# EasyEDA Pro project hardware.eprj, schematic 264主板
Create Date: 2022-11-13; Page Name: P1; Project Name: hardware; Schematic Name: 264主板; Update Date: 2022-12-20; Company: 嘉立创EDA; Page Size: D; Version: V1.0
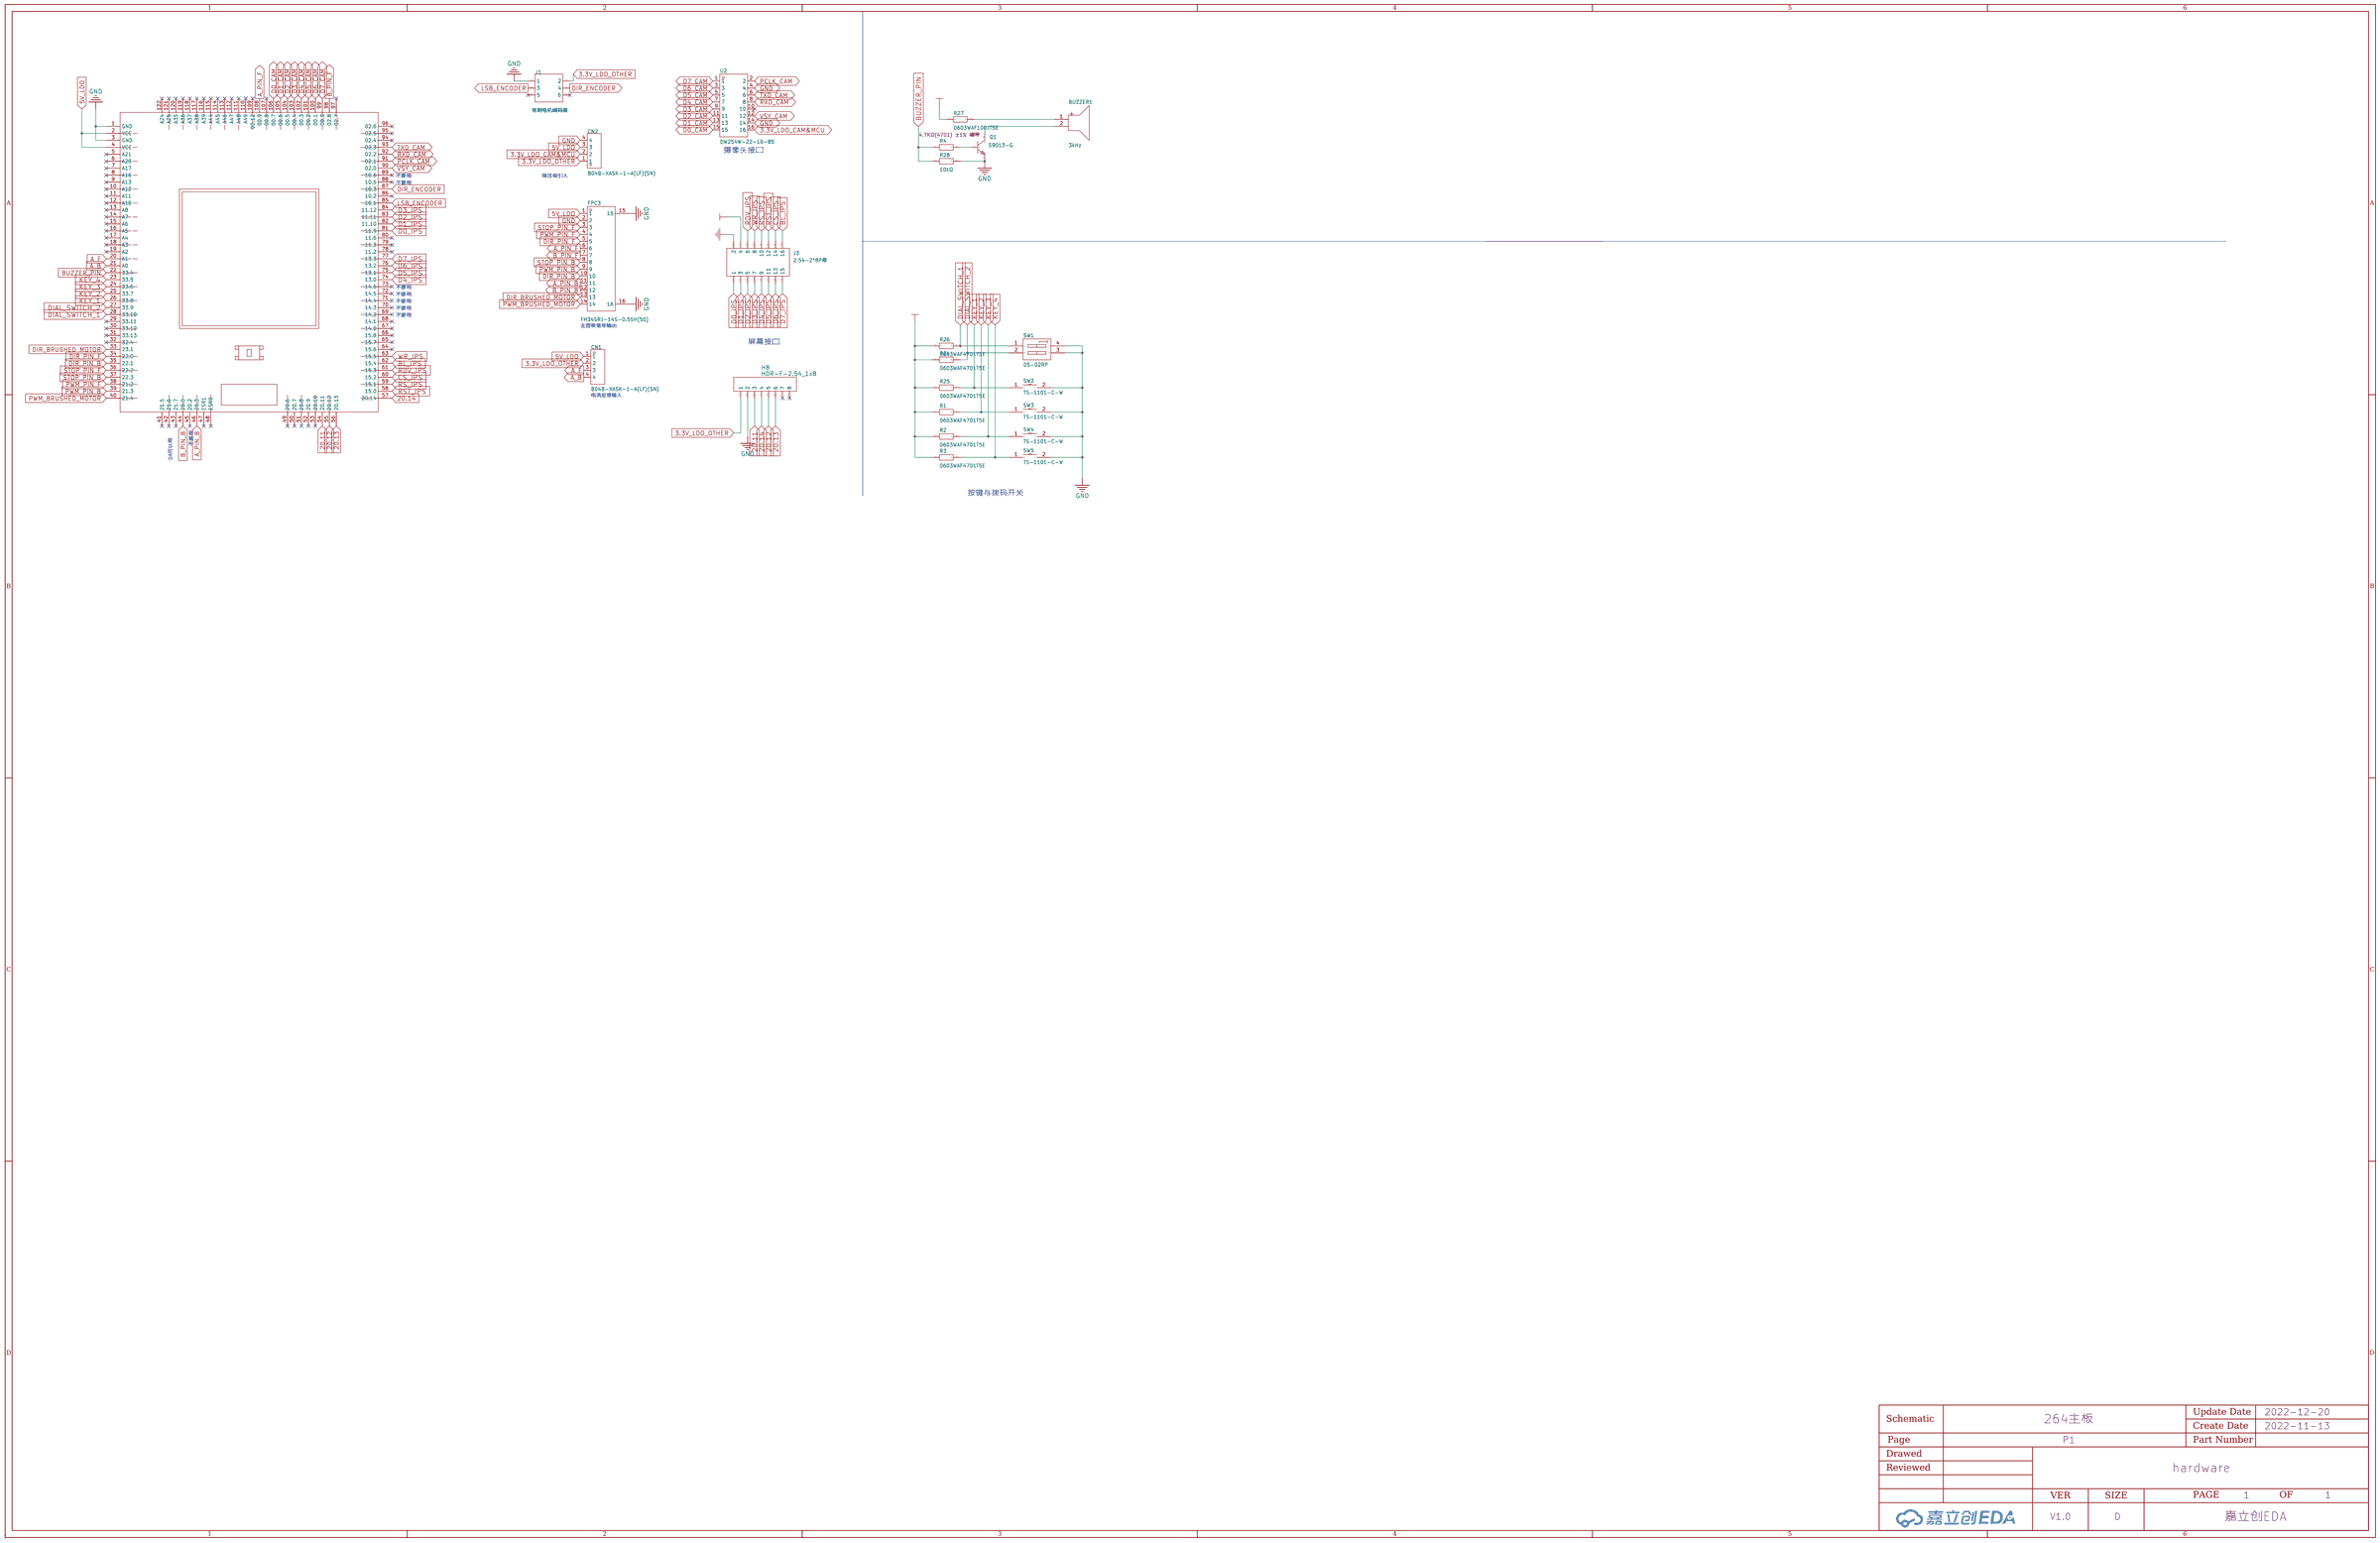
[diagram p0: schematic sheet]

## Parts
BUZZER1  3kHz  [BUZ-TH_BD9.0-P5.00-D0.6-FD]
CN1  B04B-XASK-1-A(LF)(SN)  [CONN-TH_B04B-XASK-1-A-LF-SN]
CN2  B04B-XASK-1-A(LF)(SN)  [CONN-TH_B04B-XASK-1-A-LF-SN]
FPC3  FH34SRJ-14S-0.5SH(50)  [FFC-SMD_14P-P0.50_FH34SRJ-14S-0.5SH]
H8  HDR-F-2.54_1x8  [HDR-F-2.54_1X8]
J1  有刷电机编码器  [HDR-TH_6P-P2.54-V-M-R2-C3-S2.54-1]
J3  2.54-2*8P母  [HDR-TH_16P-P2.54-V-F-R2-C8-S2.54-1]
Q1  S9013-G  [SOT-23-3_L2.9-W1.3-P1.90-LS2.4-BR]
R1  0603WAF4701T5E  [R0603]
R2  0603WAF4701T5E  [R0603]
R3  0603WAF4701T5E  [R0603]
R4  0603WAF4701T5E  [R0603]
R24  0603WAF4701T5E  [R0603]
R25  0603WAF4701T5E  [R0603]
R26  0603WAF4701T5E  [R0603]
R27  0603WAF100JT5E  [R0603]
R28  10kΩ  [R0603]
SW1  DS-02RP  [SW-TH_DS-02XP]
SW2  TS-1101-C-W  [SW-SMD_L6.0-W3.3-LS8.0]
SW3  TS-1101-C-W  [SW-SMD_L6.0-W3.3-LS8.0]
SW4  TS-1101-C-W  [SW-SMD_L6.0-W3.3-LS8.0]
SW5  TS-1101-C-W  [SW-SMD_L6.0-W3.3-LS8.0]
U1  TC387核心板 COPY  [TC264逐飞]
U2  DW254W-22-16-85  [HDR-TH_16P-P2.54-H-F-R2-C8-S2.54-W12.7-N]

## Library data of the parts
BUZZER1 = HNB09A03: 驱动方式:电磁式;构造类型:有源;额定电压:3V;工作电压:1.5V~4.5V;消耗电流:30mA;频率:3kHz;声压(SPL):85dB@10cm;直径(φD):9mm;长度:-;宽度:-;高度:5.5mm;工作温度:-20~+70;; LCSC Part Name: 电磁式有源一体蜂鸣器HNB09A03; Supplier Part: C96102; Manufacturer: 华能; Supplier Footprint: 插件,P=5mm; JLCPCB Part Class: Extended Part; Datasheet: https://atta.szlcsc.com/upload/public/pdf/source/20170522/1495448326172.pdf; Supplier: LCSC; Oscillator Circuit: 电磁式; Technology Type: 有源; Rated Voltage: 3V; Operating Voltage: 1.5V~4.5V; Current Consumption: 30mA; Sound Pressure Level (SPL): 85dB@10cm; Diameter (φD): 9mm; Height: 5.5mm; Operating Temperature: -20~+70
CN1 CN2 = B04B-XASK-1-A(LF)(SN): 参考系列:XA;间距:2.5mm;插针结构:1x4P;排数:1;每排PIN数:4;行距:-;公母:公型插针;安装方式:直插;额定电流:3A;工作温度范围:-25~+85;; LCSC Part Name: 4P 脚距2.5mm; Supplier Part: C491709; Manufacturer: JST; Supplier Footprint: 插件,P=2.5mm; JLCPCB Part Class: Extended Part; Datasheet: https://atta.szlcsc.com/upload/public/pdf/source/20200416/C514162_2DCD7D1CD2019D14145B8FEA1B6236C2.pdf; Supplier: LCSC; Reference Series: XA; Pitch: 2.5mm; Pins Structure: 1x4P; Number of Rows: 1; Number of PINs Per Row: 4; Gender: 公型插针; Mounting Style: 直插; Current Rating (Max): 3A; Operating Temperature Range: -25~+85
FPC3 = FH34SRJ-14S-0.5SH(50): 间距:0.5mm;触点数量:14;锁定特性:-;安装类型:卧贴;触点类型:双侧触点/上下接;; LCSC Part Name: 0.5mm P数:14 双侧触点/上下接; Supplier Part: C324724; Manufacturer: HRS(广濑); Supplier Footprint: SMD,P=0.5mm; JLCPCB Part Class: Extended Part; Datasheet: https://atta.szlcsc.com/upload/public/pdf/source/20181106/C324724_DC7CE3D3468642B05BE9C7F247386E31.pdf; Supplier: LCSC; Pitch: 0.5mm; Number of Contacts: 14; Mounting Type: 卧贴; Contact Type: 双侧触点/上下接; Height Above Board: 1mm; FFC, FCB Thickness: 0.3mm
H8 = HDR-F-2.54_1x8: Supplier Part: C225505; Supplier: LCSC
J1 = 2.54-2*3P针: 间距:2.54mm;总PIN位数:6;排数:2;插针结构:-;行距:-;安装类型:直插;圆针/方针:-;额定电流:-;额定电压:-;配合针长度:-;塑高:-;触头材质:-;触头镀层:-;颜色:黑色;; LCSC Part Name: 2.54mm 直插; Supplier Part: C65114; Manufacturer: BOOMELE(博穆精密); Supplier Footprint: 直插,P=2.54mm; JLCPCB Part Class: Extended Part; Datasheet: https://atta.szlcsc.comnull; Supplier: LCSC; Pitch: 2.54mm; Number of Pins: 6; Number of Rows: 2; Mounting Type: 直插; Color: 黑色
J3 = 2.54-2*8P母: 间距:2.54mm;总孔位数:16;排数:2;插孔结构:2x8P;行距:2.54mm;安装类型:直插;塑高:-;触头材质:黄铜;触头镀层:-;; LCSC Part Name: 2.54mm 2x8P; Supplier Part: C30734; Manufacturer: BOOMELE(博穆精密); Supplier Footprint: 直插,P=2.54mm; JLCPCB Part Class: Extended Part; Datasheet: https://atta.szlcsc.com/upload/public/pdf/source/20151109/1457707555924.pdf; Supplier: LCSC; Pitch: 2.54mm; Number of Holes: 16; Number of Rows: 2; Holes Structure: 2x8P; Row Spacing: 2.54mm; Mounting Type: 直插; Contact Material: 黄铜
Q1 = S9013-G: 晶体管类型:NPN;集射极击穿电压(Vceo):25V;集电极电流(Ic):500mA;功率(Pd):300mW;; LCSC Part Name: S9013 H档(200-350) H档(200-350); Supplier Part: C164888; Manufacturer: CJ(江苏长电/长晶); Supplier Footprint: SOT-23(SOT-23-3); JLCPCB Part Class: Extended Part; Datasheet: https://atta.szlcsc.com/upload/public/pdf/source/20171228/C164888_15144412896081213891.pdf; Supplier: LCSC; Transistor Type: NPN; Collector-Emitter Breakdown Voltage (Vceo): 25V; Collector Current (Ic): 500mA; Power Dissipation (Pd): 300mW
R1-R4 R24-R26 = 0603WAF4701T5E: LCSC Part Name: 4.7KΩ(4701) ±1% 编带; Supplier Part: C23162; Manufacturer: UNI-ROYAL(厚声); Supplier Footprint: 0603; JLCPCB Part Class: Basic Part; Datasheet: https://atta.szlcsc.com/upload/public/pdf/source/20170920/C23162_1505901109673982545.pdf; Supplier: LCSC
R27 = 0603WAF100JT5E: LCSC Part Name: 10Ω(10R0) ±1% 编带; Supplier Part: C22859; Manufacturer: UNI-ROYAL(厚声); Supplier Footprint: 0603; JLCPCB Part Class: Basic Part; Datasheet: https://atta.szlcsc.com/upload/public/pdf/source/20170920/C22859_1505900954295982249.pdf; Supplier: LCSC
R28 = 0603WAF1002T5E: 电阻类型:厚膜电阻;阻值:10kΩ;精度:±1%;功率:100mW;温度系数:±100ppm/;最大工作电压:75V;工作温度范围:-55~+155;; LCSC Part Name: 10kΩ ±1% 100mW; Supplier Part: C25804; Manufacturer: UNI-ROYAL(厚声); Supplier Footprint: 0603; JLCPCB Part Class: Basic Part; Datasheet: https://atta.szlcsc.com/upload/public/pdf/source/20200306/C422600_1E6D84923E4A46A82E41ADD87F860B5C.pdf; Supplier: LCSC; Type: 厚膜电阻; Tolerance: ±1%; Power(Watts): 100mW; Temperature Coefficient: ±100ppm/; Overload Voltage (Max): 75V; Operating Temperature Range: -55~+155
SW1 = DS-02RP: 类型:平拨，凸起式;额定电流:25mA;额定电压:24V;电路结构:单刀单掷;开关位数:2;引脚间距:2.54mm;工作温度:-20~+70;使用寿命:3000;颜色:红色;; LCSC Part Name: 红色2PIN-2.54mm立式直插正拨拨码开关; Supplier Part: C92646; Manufacturer: 韩国韩荣; Supplier Footprint: 插件; JLCPCB Part Class: Extended Part; Datasheet: https://atta.szlcsc.com/upload/public/pdf/source/20210810/ECF2F28B1CE673E7F9581E27682BDB10.pdf; Supplier: LCSC; Type: 平拨，凸起式; Current Rating: 25mA; Voltage Rating: 24V; Circuit: 单刀单掷; Number of Positions: 2; Lead Pitch: 2.54mm; Operating Temperature: -20~+70; Operating Life: 3000; Color: 红色
SW2-SW5 = TS-1101-C-W: 触点电流:50mA;额定电压(DC):12V;绝缘电阻:100mΩ;电路结构:单刀单掷;安装方式:立贴;按钮形状:矩形按钮;按钮/盖帽颜色:白色;带灯:无;作用力:260gf;机械寿命:50000;工作温度:-30~+85;开关长度:6mm;开关宽度:3.6mm;开关高度:2.5mm;带支架:否;; LCSC Part Name: TS-1101-C-W 一型3*6*2.5有白ZD b拉伸白色按键 卷装; Supplier Part: C318938; Manufacturer: XKB Connectivity(中国星坤); Supplier Footprint: SMD; JLCPCB Part Class: Extended Part; Datasheet: https://atta.szlcsc.com/upload/public/pdf/source/20200227/C318938_C2E53B1EEDE37D980A33616AC086DE53.pdf; Supplier: LCSC; Contact Current: 50mA; Voltage Rating (DC): 12V; Insulation Resistance: 100mΩ; Circuit: 单刀单掷; Mounting Style: 立贴; Actuator Style: 矩形按钮; Actuator/Cap Color: 白色; With Lamp: 无; Operating Force: 260gf; Mechanical Life: 50000; Operating Temperature: -30~+85; Switch Length: 6mm; Switch Width: 3.6mm; Switch Height: 2.5mm; Strike Gundam: 否
U1 = TC264核心板 COPY: Supplier: 逐飞
U2 = DW254W-22-16-85: 间距:2.54mm;总孔位数:16;排数:2;插孔结构:2x8P;行距:2.54mm;安装类型:弯插;圆孔/方孔:方孔;额定电流:3A;额定电压:-;插孔方向:侧面;塑高:8.5mm;工作温度范围:-;; LCSC Part Name: 2.54mm 2x8P; Supplier Part: C2936005; Manufacturer: DEALON(德艺隆); Supplier Footprint: 弯插,P=2.54mm; JLCPCB Part Class: Extended Part; Datasheet: https://atta.szlcsc.com/upload/public/pdf/source/20211231/D29517537FCFFABF14C4453E96D14918.pdf; Supplier: LCSC; Pitch: 2.54mm; Number of Holes: 16; Number of Rows: 2; Holes Structure: 2x8P; Row Spacing: 2.54mm; Mounting Type: 弯插; Circular Hole / Square Hole: 方孔; Current Rating (Max): 3A; Holes Direction: 侧面; Insulation Height: 8.5mm

## Nets
3.3V_LDO_CAM&MCU: CN2.2 U2.16
3.3V_LDO_OTHER: CN1.2 CN2.1 H8.1 J1.2 J3.4 R1.1 R2.1 R3.1 R24.1 R25.1 R26.1 R27.1
5V_LDO: CN1.1 CN2.3 FPC3.1 U1.2(VCC) U1.4(VCC)
GND: CN2.4 FPC3.2 FPC3.15 FPC3.16 H8.2 J1.1 J3.2 Q1.2(E) R28.2 SW1.3 SW1.4 SW2.2 SW3.2 SW4.2 SW5.2 U1.1(GND) U1.3(GND) U2.4 U2.14
20.11: H8.3 U1.54(20.11)
20.12: H8.5 U1.55(20.12)
20.13: H8.6 U1.56(20.13)
20.14: H8.4 U1.57(20.14)
A_B: CN1.4 U1.21(A0)
A_F: CN1.3 U1.20(A1)
A_PIN_B: FPC3.11 U1.46(20.3)
A_PIN_F: FPC3.6 U1.108(00.9)
B_PIN_B: FPC3.12 U1.44(20.0)
B_PIN_F: FPC3.7 U1.98(02.8)
BL_IPS: J3.16 U1.62(15.4)
BUZZER_PIN: R4.1 R28.1 U1.22(33.4)
CS_IPS: J3.14 U1.60(15.2)
D0_CAM: U1.106(00.7) U2.15
D0_IPS: J3.1 U1.81(11.9)
D1_CAM: U1.105(00.6) U2.13
D1_IPS: J3.3 U1.82(11.10)
D2_CAM: U1.104(00.5) U2.11
D2_IPS: J3.5 U1.83(11.11)
D3_CAM: U1.103(00.4) U2.9
D3_IPS: J3.7 U1.84(11.12)
D4_CAM: U1.102(00.3) U2.7
D4_IPS: J3.9 U1.74(13.0)
D5_CAM: U1.101(00.2) U2.5
D5_IPS: J3.11 U1.75(13.1)
D6_CAM: U1.100(00.1) U2.3
D6_IPS: J3.13 U1.76(13.2)
D7_CAM: U1.99(00.0) U2.1
D7_IPS: J3.15 U1.77(13.3)
DIAL_SWITCH_1: R26.2 SW1.1(A1) U1.28(33.10)
DIAL_SWITCH_2: R24.2 SW1.2(A2) U1.27(33.9)
DIR_BRUSHED_MOTOR: FPC3.13 U1.33(23.1)
DIR_ENCODER: J1.4 U1.87(10.3)
DIR_PIN_B: FPC3.10 U1.35(22.1)
DIR_PIN_F: FPC3.5 U1.34(22.0)
KEY_1: R25.2 SW2.1 U1.26(33.8)
KEY_2: R1.2 SW3.1 U1.25(33.7)
KEY_3: R2.2 SW4.1 U1.24(33.6)
KEY_4: R3.2 SW5.1 U1.23(33.5)
LSB_ENCODER: J1.3 U1.85(10.1)
PCLK_CAM: U1.91(02.1) U2.2
PWM_BRUSHED_MOTOR: FPC3.14 U1.40(21.4)
PWM_PIN_B: FPC3.9 U1.39(21.3)
PWM_PIN_F: FPC3.4 U1.38(21.2)
RDV_IPS: J3.6 U1.61(15.3)
RS_IPS: J3.10 U1.59(15.1)
RST_IPS: J3.12 U1.58(15.0)
RXD_CAM: U1.92(02.2) U2.8
STOP_PIN_B: FPC3.8 U1.37(22.3)
STOP_PIN_F: FPC3.3 U1.36(22.2)
TXD_CAM: U1.93(02.3) U2.6
VSY_CAM: U1.90(02.0) U2.12
WR_IPS: J3.8 U1.63(15.5)
$1N70527: BUZZER1.1(+) R27.2
$1N70530: Q1.1(B) R4.2
$1N70531: BUZZER1.2(-) Q1.3(C)

Not connected (* = marked no-connect by the designer): H8 7* 8*; J1 5* 6*; U1 5(A21)* 6(A20)* 7(A17)* 8(A16)* 9(A13)* 10(A12)* 11(A11)* 12(A10)* 13(A8)* 14(A7)* 15(A6)* 16(A5)* 17(A4)* 18(A3)* 19(A2)* 29(33.11)* 30(33.12)* 31(33.13)* 32(32.4)* 41(21.5)* 42(21.6)* 43(21.7)* 45(20.2)* 47(ESR1)* 48(ESR0)* 49(20.6)* 50(20.7)* 51(20.8)* 52(20.9)* 53(20.10)* 64(15.6)* 65(15.7)* 66(15.8)* 67(14.0)* 68(14.1)* 69(14.2)* 70(14.3)* 71(14.4)* 72(14.5)* 73(14.6)* 78(11.2)* 79(11.3)* 80(11.6)* 86(10.2)* 88(10.5)* 89(10.6)* 94(02.4)* 95(02.5)* 96(02.6)* 97(02.7)* 107(00.8)* 109(00.12)* 110(A49)* 111(A48)* 112(A47)* 113(A46)* 114(A45)* 115(A44)* 116(A39)* 117(A38)* 118(A37)* 119(A36)* 120(A35)* 121(A25)* 122(A24)*; U2 10*

## Notes on the sheet
- 摄像头接口
- 不要用
- 降压板引入
- 不要用
- 不要用
- 不要用
- 不要用
- 不要用
- 不要用
- 主控板信号输出
- 屏幕接口
- 电流反馈输入
- 不要用
- DA可以用
- 按键与拨码开关
